# EasyEDA Pro project STM32G303的双FOC电机驱动.eprj, schematic axdr_v1.2
Board Name: foc_driver_1; Create Date: 2024-01-29; Page Name: P1; Project Name: 基于STM32G4的FOC电机驱动学习板; Schematic Name: schematic1; Update Date: 2024-02-05; Company: 嘉立创EDA
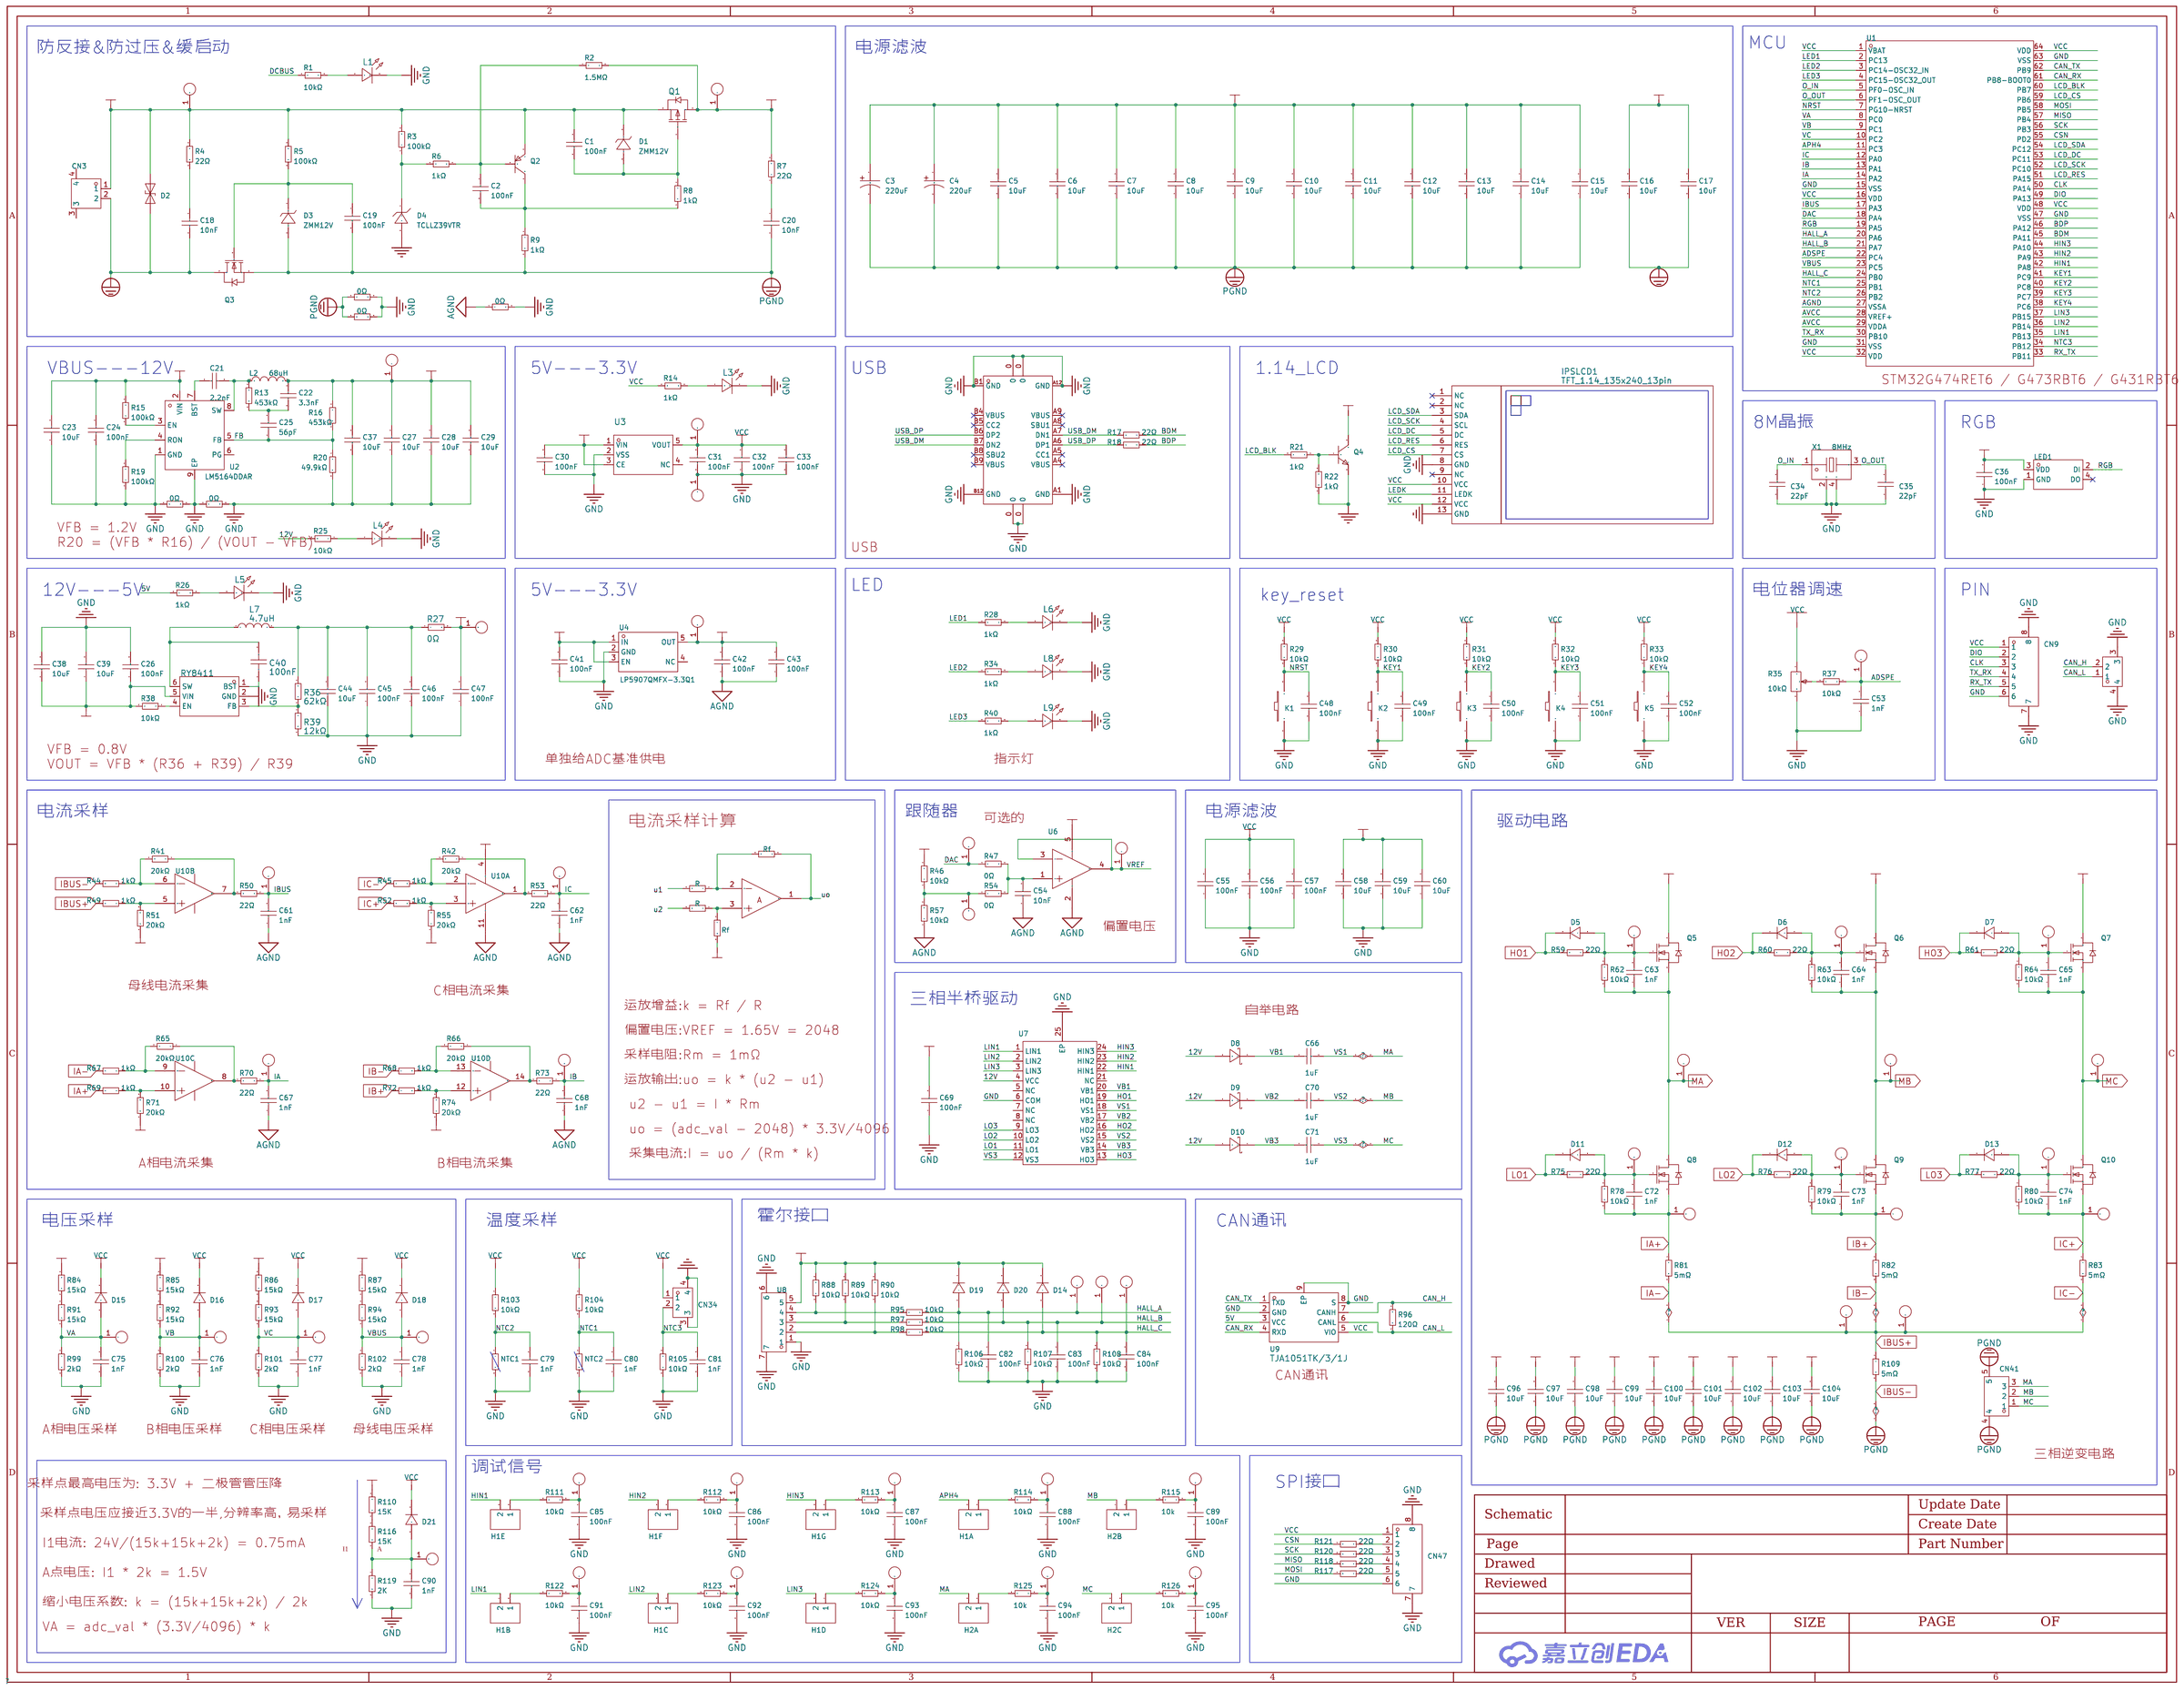
[diagram p0: schematic sheet]

## Parts
C1  100nF  [C0603_S]
C2  100nF  [C0603_S]
C3  220uF  [CAP-SMD_BD10.0-L10.3-W10.3-LS11.0-R-RD]
C4  220uF  [CAP-SMD_BD10.0-L10.3-W10.3-LS11.0-R-RD]
C5  10uF  [C1206_S]
C6  10uF  [C1206_S]
C7  10uF  [C1206_S]
C8  10uF  [C1206_S]
C9  10uF  [C1206_S]
C10  10uF  [C1206_S]
C11  10uF  [C1206_S]
C12  10uF  [C1206_S]
C13  10uF  [C1206_S]
C14  10uF  [C1206_S]
C15  10uF  [C1206_S]
C16  10uF  [C1206_S]
C17  10uF  [C1206_S]
C18  10nF  [C0603_S]
C19  100nF  [C0603_S]
C20  10nF  [C0603_S]
C21  2.2nF  [C0603_S]
C22  3.3nF  [C0603_S]
C23  10uF  [C1206_S]
C24  100nF  [C1206_S]
C25  2.2nF  [C0603_S]
C26  100nF  [C0603_S]
C27  10uF  [C0603_S]
C28  10uF  [C0603_S]
C29  10uF  [C1206_S]
C30  100nF  [C0603_S]
C31  100nF  [C0603_S]
C32  100nF  [C0603_S]
C33  100nF  [C0603_S]
C34  22pF  [C0603_S]
C35  22pF  [C0603_S]
C36  100nF  [C0603_S]
C37  10uF  [C0603_S]
C38  10uF  [C0603_S]
C39  10uF  [C0603_S]
C40  100nF  [C0603_S_3]
C41  100nF  [C0603_S]
C42  100nF  [C0603_S]
C43  100nF  [C0603_S]
C44  10uF  [C0805_S]
C45  100nF  [C0603_S]
C46  100nF  [C0603_S]
C47  100nF  [C0603_S]
C48  100nF  [C0603_S]
C49  100nF  [C0603_S]
C50  100nF  [C0603_S]
C51  100nF  [C0603_S]
C52  100nF  [C0603_S]
C53  1nF  [C0603_S]
C54  10nF  [C0603_S]
C55  100nF  [C0603_S]
C56  100nF  [C0603_S]
C57  100nF  [C0603_S]
C58  10uF  [C0603_S]
C59  10uF  [C0603_S]
C60  10uF  [C0603_S]
C61  1nF  [C0603_S]
C62  1nF  [C0603_S]
C63  1nF  [C0603_S]
C64  1nF  [C0603_S]
C65  1nF  [C0603_S]
C66  1uF  [C0603_S]
C67  1nF  [C0603_S]
C68  1nF  [C0603_S]
C69  100nF  [C0603_S]
C70  1uF  [C0603_S]
C71  1uF  [C0603_S]
C72  1nF  [C0603_S]
C73  1nF  [C0603_S]
C74  1nF  [C0603_S]
C75  1nF  [C0603_S]
C76  1nF  [C0603_S]
C77  1nF  [C0603_S]
C78  1nF  [C0603_S]
C79  1nF  [C0603_S]
C80  1nF  [C0603_S]
C81  1nF  [C0603_S]
C82  100nF  [C0603_S]
C83  100nF  [C0603_S]
C84  100nF  [C0603_S]
C85  100nF  [C0603_S]
C86  100nF  [C0603_S]
C87  100nF  [C0603_S]
C88  100nF  [C0603_S]
C89  100nF  [C0603_S]  (no BOM)
C90  1nF  [C0603_S]  (no BOM)
C91  100nF  [C0603_S]
C92  100nF  [C0603_S]
C93  100nF  [C0603_S]
C94  100nF  [C0603_S]  (no BOM)
C95  100nF  [C0603_S]  (no BOM)
C96  10uF  [C1206_S]
C97  10uF  [C1206_S]
C98  10uF  [C1206_S]
C99  10uF  [C1206_S]
C100  10uF  [C1206_S]
C101  10uF  [C1206_S]
C102  10uF  [C1206_S]
C103  10uF  [C1206_S]
C104  10uF  [C1206_S]
CN1  5012  [TESTPOINT-TH_BD2.0_C9900010656]  (no BOM)
CN2  5012  [TESTPOINT-TH_BD2.0_C9900010656]  (no BOM)
CN3  XT30PW-F  [CONN-TH_XT30PW-F]
CN4  5012  [TESTPOINT-TH_BD2.0_C9900010656]  (no BOM)
CN5  5012  [TESTPOINT-TH_BD2.0_C9900010656]  (no BOM)
CN6  5012  [TESTPOINT-TH_BD2.0_C9900010656]  (no BOM)
CN7  5012  [TESTPOINT-TH_BD2.0_C9900010656]  (no BOM)
CN8  5012  [TESTPOINT-TH_BD2.0_C9900010656]  (no BOM)
CN9  WAFER-GH1.25-6PWB  [CONN-SMD_6P-P1.25_XUNPU_WAFER-GH1.25-6PWB]
CN10  5012  [TESTPOINT-TH_BD2.0_C9900010656]  (no BOM)
CN11  X1251WRS-02HF-LPSW  [CONN-SMD_2P-P1.25_X1251WRS-02HF-LPSW]
CN12  5012  [TESTPOINT-TH_BD2.0_C9900010656]  (no BOM)
CN13  5012  [TESTPOINT-TH_BD2.0_C9900010656]  (no BOM)
CN14  5012  [TESTPOINT-TH_BD2.0_C9900010656]  (no BOM)
CN15  5012  [TESTPOINT-TH_BD2.0_C9900010656]  (no BOM)
CN16  5012  [TESTPOINT-TH_BD2.0_C9900010656]  (no BOM)
CN17  5012  [TESTPOINT-TH_BD2.0_C9900010656]  (no BOM)
CN18  5012  [TESTPOINT-TH_BD2.0_C9900010656]  (no BOM)
CN19  5012  [TESTPOINT-TH_BD2.0_C9900010656]  (no BOM)
CN20  5012  [TESTPOINT-TH_BD2.0_C9900010656]  (no BOM)
CN21  5012  [TESTPOINT-TH_BD2.0_C9900010656]  (no BOM)
CN22  5012  [TESTPOINT-TH_BD2.0_C9900010656]  (no BOM)
CN23  5012  [TESTPOINT-TH_BD2.0_C9900010656]  (no BOM)
CN24  5012  [TESTPOINT-TH_BD2.0_C9900010656]  (no BOM)
CN25  5012  [TESTPOINT-TH_BD2.0_C9900010656]  (no BOM)
CN26  5012  [TESTPOINT-TH_BD2.0_C9900010656]  (no BOM)
CN27  5012  [TESTPOINT-TH_BD2.0_C9900010656]  (no BOM)
CN28  5012  [TESTPOINT-TH_BD2.0_C9900010656]  (no BOM)
CN29  5012  [TESTPOINT-TH_BD2.0_C9900010656]  (no BOM)
CN30  5012  [TESTPOINT-TH_BD2.0_C9900010656]  (no BOM)
CN31  5012  [TESTPOINT-TH_BD2.0_C9900010656]  (no BOM)
CN32  5012  [TESTPOINT-TH_BD2.0_C9900010656]  (no BOM)
CN33  5012  [TESTPOINT-TH_BD2.0_C9900010656]  (no BOM)
CN34  X1251WRS-02HF-LPSW  [CONN-SMD_2P-P1.25_X1251WRS-02HF-LPSW]
CN35  5012  [TESTPOINT-TH_BD2.0_C9900010656]  (no BOM)
CN36  5012  [TESTPOINT-TH_BD2.0_C9900010656]  (no BOM)
CN37  5012  [TESTPOINT-TH_BD2.0_C9900010656]  (no BOM)
CN38  5012  [TESTPOINT-TH_BD2.0_C9900010656]  (no BOM)
CN39  5012  [TESTPOINT-TH_BD2.0_C9900010656]  (no BOM)
CN40  5012  [TESTPOINT-TH_BD2.0_C9900010656]  (no BOM)
CN41  MR30PW-F  [CONN-TH_MR30PW-F]
CN42  5012  [TESTPOINT-TH_BD2.0_C9900010656]  (no BOM)
CN43  5012  [TESTPOINT-TH_BD2.0_C9900010656]  (no BOM)
CN44  5012  [TESTPOINT-TH_BD2.0_C9900010656]  (no BOM)
CN45  5012  [TESTPOINT-TH_BD2.0_C9900010656]  (no BOM)
CN46  5012  [TESTPOINT-TH_BD2.0_C9900010656]  (no BOM)
CN47  WAFER-GH1.25-6PWB  [CONN-SMD_6P-P1.25_XUNPU_WAFER-GH1.25-6PWB]
CN48  5012  [TESTPOINT-TH_BD2.0_C9900010656]  (no BOM)
CN49  5012  [TESTPOINT-TH_BD2.0_C9900010656]  (no BOM)
CN50  5012  [TESTPOINT-TH_BD2.0_C9900010656]  (no BOM)
CN51  5012  [TESTPOINT-TH_BD2.0_C9900010656]  (no BOM)
CN52  5012  [TESTPOINT-TH_BD2.0_C9900010656]  (no BOM)
CN53  5012  [TESTPOINT-TH_BD2.0_C9900010656]  (no BOM)
D1  ZMM12V  [LL-34_L3.5-W1.5-RD-2]
D2  1.5SMC30CAHE3/57T  [SMC_L6.8-W5.9-LS7.8-BI]
D3  ZMM12V  [LL-34_L3.5-W1.5-RD-2]
D4  TCLLZ39VTR  [LL-34_L3.5-W1.5-RD]
D5  B16WS  [SOD-323_L1.8-W1.3-LS2.5-RD]
D6  B16WS  [SOD-323_L1.8-W1.3-LS2.5-RD]
D7  B16WS  [SOD-323_L1.8-W1.3-LS2.5-RD]
D8  B16WS  [SOD-323_L1.8-W1.3-LS2.5-RD]
D9  B16WS  [SOD-323_L1.8-W1.3-LS2.5-RD]
D10  B16WS  [SOD-323_L1.8-W1.3-LS2.5-RD]
D11  B16WS  [SOD-323_L1.8-W1.3-LS2.5-RD]
D12  B16WS  [SOD-323_L1.8-W1.3-LS2.5-RD]
D13  B16WS  [SOD-323_L1.8-W1.3-LS2.5-RD]
D14  B16WS  [SOD-323_L1.8-W1.3-LS2.5-RD]
D15  B16WS  [SOD-323_L1.8-W1.3-LS2.5-RD]
D16  B16WS  [SOD-323_L1.8-W1.3-LS2.5-RD]
D17  B16WS  [SOD-323_L1.8-W1.3-LS2.5-RD]
D18  B16WS  [SOD-323_L1.8-W1.3-LS2.5-RD]
D19  B16WS  [SOD-323_L1.8-W1.3-LS2.5-RD]
D20  B16WS  [SOD-323_L1.8-W1.3-LS2.5-RD]
D21  -  [SOD-323_L1.8-W1.3-LS2.5-RD]  (no BOM)
H1  2.54-2*7P针  [HDR-TH_14P-P2.54-V-F-R2-C6-S2.54]  (sections 1,2,3,4,5,6,7)
H2  X6521WV-2x03H-C60D30  [HDR-TH_6P-P2.54-V-M-R2-C3-S2.54]  (sections 1,2,3)  (no BOM)
IPSLCD1  TFT_1.14_135x240_13pin  [焊接式_TFT_1.14_135X240_13PIN]
K1  TS-KG02S  [SW-SMD_4P-L6.0-W6.0-P4.50-LS8.5]
K2  TS-KG02S  [SW-SMD_4P-L6.0-W6.0-P4.50-LS8.5]
K3  TS-KG02S  [SW-SMD_4P-L6.0-W6.0-P4.50-LS8.5]
K4  TS-KG02S  [SW-SMD_4P-L6.0-W6.0-P4.50-LS8.5]
K5  TS-KG02S  [SW-SMD_4P-L6.0-W6.0-P4.50-LS8.5]
L1  NCD0603R1  [LED0603_S]
L2  68uH  [IND-SMD_L6.0-W6.0_SMNR6045]
L3  NCD0603R1  [LED0603_S]
L4  NCD0603R1  [LED0603_S]
L5  NCD0603R1  [LED0603_S]
L6  NCD0603G1  [LED0603_S]
L7  4.7uH  [IND-SMD_L2.5-W2.0]
L8  NCD0603W1  [LED0603_S]
L9  NCD0603B1  [LED0603_S]
LED1  XL-3528RGBW-WS2812B  [LED-SMD_4P-L3.5-W2.8-BR-1]
NTC1  NCP18XH103F03RB  [R0603_S]
NTC2  NCP18XH103F03RB  [R0603_S]
Q1  WSD90P06DN56  [DFN-8_L5.8-W4.9-P1.27-LS6.0-BL-1]
Q2  FMMT593  [SOT-23-3_L2.9-W1.3-P1.90-LS2.4-BR]
Q3  WSD80120DN56  [DFN-8_L5.8-W4.9-P1.27-LS6.0-BL-1]
Q4  SS8050  [SOT-23-3_L2.9-W1.3-P1.90-LS2.4-BR]
Q5  NCE7560K  [TO-252-2_L6.6-W6.1-P4.58-LS9.9-BR]
Q6  NCE7560K  [TO-252-2_L6.6-W6.1-P4.58-LS9.9-BR]
Q7  NCE7560K  [TO-252-2_L6.6-W6.1-P4.58-LS9.9-BR]
Q8  NCE7560K  [TO-252-2_L6.6-W6.1-P4.58-LS9.9-BR]
Q9  NCE7560K  [TO-252-2_L6.6-W6.1-P4.58-LS9.9-BR]
Q10  NCE7560K  [TO-252-2_L6.6-W6.1-P4.58-LS9.9-BR]
R1  10kΩ  [R0603_S]
R2  1.5MΩ  [R0603_S]
R3  100kΩ  [R0603_S]
R4  22Ω  [R0603_S]
R5  100kΩ  [R0603_S]
R6  1kΩ  [R0603_S]
R7  22Ω  [R0603_S]
R8  1kΩ  [R0603_S]
R9  1kΩ  [R0603_S]
R10  0Ω  [R0603_S]
R11  0Ω  [R0603_S]
R12  0Ω  [R0603_S]
R13  453kΩ  [R0603_S]
R14  1kΩ  [R0603_S]
R15  100kΩ  [R0603_S]
R16  453kΩ  [R0603_S]
R17  22Ω  [R0603_S]
R18  22Ω  [R0603_S]
R19  100kΩ  [R0603_S]
R20  49.9kΩ  [R0603_S]
R21  1kΩ  [R0603_S]
R22  1kΩ  [R0603_S]
R23  0Ω  [R0603_S]
R24  0Ω  [R0603_S]
R25  10kΩ  [R0603_S]
R26  1kΩ  [R0603_S]
R27  0Ω  [R0603_S]
R28  1kΩ  [R0603_S]
R29  10kΩ  [R0603_S]
R30  10kΩ  [R0603_S]
R31  10kΩ  [R0603_S]
R32  10kΩ  [R0603_S]
R33  10kΩ  [R0603_S]
R34  1kΩ  [R0603_S]
R35  10kΩ  [RES-ADJ-TH_3P-L9.5-W9.5-P2.50-L_3386P]
R36  62kΩ  [R0603_S]
R37  10kΩ  [R0603_S]
R38  10kΩ  [R0603_S]
R39  12kΩ  [R0603_S]
R40  1kΩ  [R0603_S]
R41  20kΩ  [R0603_S]
R42  20kΩ  [R0603_S]
R43  Rf  [R0603_S]  (no BOM)
R44  1kΩ  [R0603_S]
R45  1kΩ  [R0603_S]
R46  10kΩ  [R0603_S]
R47  0Ω  [R0603_S]
R48  R  [R0603_S]  (no BOM)
R49  1kΩ  [R0603_S]
R50  22Ω  [R0603_S]
R51  20kΩ  [R0603_S]
R52  1kΩ  [R0603_S]
R53  22Ω  [R0603_S]
R54  0Ω  [R0603_S]
R55  20kΩ  [R0603_S]
R56  R  [R0603_S]  (no BOM)
R57  10kΩ  [R0603_S]
R58  Rf  [R0603_S]  (no BOM)
R59  22Ω  [R0603_S]
R60  22Ω  [R0603_S]
R61  22Ω  [R0603_S]
R62  10kΩ  [R0603_S]
R63  10kΩ  [R0603_S]
R64  10kΩ  [R0603_S]
R65  20kΩ  [R0603_S]
R66  20kΩ  [R0603_S]
R67  1kΩ  [R0603_S]
R68  1kΩ  [R0603_S]
R69  1kΩ  [R0603_S]
R70  22Ω  [R0603_S]
R71  20kΩ  [R0603_S]
R72  1kΩ  [R0603_S]
R73  22Ω  [R0603_S]
R74  20kΩ  [R0603_S]
R75  22Ω  [R0603_S]
R76  22Ω  [R0603_S]
R77  22Ω  [R0603_S]
R78  10kΩ  [R0603_S]
R79  10kΩ  [R0603_S]
R80  10kΩ  [R0603_S]
R81  5mΩ  [R2512_S]
R82  5mΩ  [R2512_S]
R83  5mΩ  [R2512_S]
R84  15kΩ  [R0603_S]
R85  15kΩ  [R0603_S]
R86  15kΩ  [R0603_S]
R87  15kΩ  [R0603_S]
R88  10kΩ  [R0603_S]
R89  10kΩ  [R0603_S]
R90  10kΩ  [R0603_S]
R91  15kΩ  [R0603_S]
R92  15kΩ  [R0603_S]
R93  15kΩ  [R0603_S]
R94  15kΩ  [R0603_S]
R95  10kΩ  [R0603_S]
R96  120Ω  [R0603_S]
R97  10kΩ  [R0603_S]
R98  10kΩ  [R0603_S]
R99  2kΩ  [R0603_S]
R100  2kΩ  [R0603_S]
R101  2kΩ  [R0603_S]
R102  2kΩ  [R0603_S]
R103  10kΩ  [R0603_S]
R104  10kΩ  [R0603_S]
R105  10kΩ  [R0603_S]
R106  10kΩ  [R0603_S]
R107  10kΩ  [R0603_S]
R108  10kΩ  [R0603_S]
R109  5mΩ  [R2512_S]
R110  15K  [R0603_S]  (no BOM)
R111  10kΩ  [R0603_S]
R112  10kΩ  [R0603_S]
R113  10kΩ  [R0603_S]
R114  10kΩ  [R0603_S]
R115  10k  [R0603_S]  (no BOM)
R116  15K  [R0603_S]  (no BOM)
R117  22Ω  [R0603_S]
R118  22Ω  [R0603_S]
R119  2K  [R0603_S]  (no BOM)
R120  22Ω  [R0603_S]
R121  22Ω  [R0603_S]
R122  10kΩ  [R0603_S]
R123  10kΩ  [R0603_S]
R124  10kΩ  [R0603_S]
R125  10k  [R0603_S]  (no BOM)
R126  10k  [R0603_S]  (no BOM)
U1  STM32G431RBT6  [LQFP-64_L10.0-W10.0-P0.50-LS12.0-BL]
U2  LM5164DDAR  [ESOP-8_L4.9-W3.9-P1.27-LS6.0-BL-EP]
U3  XC6210B332MR  [SOT-23-5_L3.0-W1.7-P0.95-LS2.8-BR]
U4  LP5907QMFX-3.3Q1  [SOT-23-5_L3.0-W1.7-P0.95-LS2.8-BR]
U5  RY8411  [SOT-23-6_L2.9-W1.6-P0.95-LS2.8-BR]
U6  LM321MF/NOPB  [SOT-23-5_L3.0-W1.7-P0.95-LS2.8-BR]
U7  FD6288Q  [QFN-24_L4.0-W4.0-P0.50-BL-EP2.6]
U8  WAFER-GH1.25-5PWB  [CONN-SMD_5P-P1.25_XUNPU_WAFER-GH1.25-5PWB]
U9  TJA1051TK/3/1J  [HVSON-8_L3.0-W3.0-P0.65-BL-EP]
U10  RS624XQ  [TSSOP-14_L5.0-W4.4-P0.65-LS6.4-BL]  (sections 1,2,3,4)
U11  LM358  [SOP-8_L4.9-W3.9-P1.27-LS6.0-BL]  (section 1)  (no BOM)
USBC1  -  [USB-C_SMD-TYPE-C-31-M-12]
X1  8MHz  [CRYSTAL-SMD_4P-L3.2-W2.5-BL]

## Library data of the parts
C1 C2 C19 C26 C30-C33 C36 C41-C43 C45-C52 C55-C57 C69 C82-C88 C91-C93 = 0603B104K500NT: 容值:100nF;精度:±10%;额定电压:50V;材质(温度系数):X7R;; LCSC Part Name: 100nF ±10% 50V; Supplier Part: C30926; Manufacturer: FH(风华); Supplier Footprint: 0603; JLCPCB Part Class: Extended Part; Datasheet: https://atta.szlcsc.com/upload/public/pdf/source/20200305/C486355_26A10D38EF8C2A5C37091D0039909270.pdf; Supplier: LCSC; Tolerance: ±10%; Voltage Rated: 50V; Temperature Coefficient: X7R; Pin Type: IN; Check: true
C3 C4 = 50TZV220M10X10.5: 容值:220uF;精度:±20%;额定电压:50V;纹波电流:402mA@120Hz;等效串联电阻:-;; LCSC Part Name: 220uF ±20% 50V; Supplier Part: C88818; Manufacturer: rubycon(红宝石); Supplier Footprint: SMD,D10xL10.5mm; JLCPCB Part Class: Extended Part; Datasheet: https://atta.szlcsc.com/upload/public/pdf/source/20171014/C108861_15079752546651037911.pdf; Supplier: LCSC; Tolerance: ±20%; Rated Voltage: 50V; Ripple Current: 402mA@120Hz; φD: 10mm; L: 10.5mm; Lifetime @ Temp: 2000hrs@105℃; Operating Temperature: -55℃~+105℃; Check: true
C5-C17 C29 C96-C104 = CL31A106KBHNNNE: 容值:10uF;精度:±10%;额定电压:50V;材质(温度系数):X5R;; LCSC Part Name: 10uF ±10% 50V; Supplier Part: C13585; Manufacturer: SAMSUNG(三星); Supplier Footprint: 1206; JLCPCB Part Class: Basic Part; Datasheet: https://atta.szlcsc.com/upload/public/pdf/source/20160218/1457707763339.pdf; Supplier: LCSC; Tolerance: ±10%; Voltage Rated: 50V; Temperature Coefficient: X5R; Pin Type: IN; 值: 10UF; Check: true
C18 C20 C54 = 0603B103K500NT: 容值:10nF;精度:±10%;额定电压:50V;材质(温度系数):X7R;; LCSC Part Name: 10nF ±10% 50V; Supplier Part: C57112; Manufacturer: FH(风华); Supplier Footprint: 0603; JLCPCB Part Class: Basic Part; Datasheet: https://atta.szlcsc.com/upload/public/pdf/source/20200305/C486355_26A10D38EF8C2A5C37091D0039909270.pdf; Supplier: LCSC; Tolerance: ±10%; Voltage Rated: 50V; Temperature Coefficient: X7R; Pin Type: IN; Check: true
C21 C25 = 0603B222K500NT: 容值:2.2nF;精度:±10%;额定电压:50V;材质(温度系数):X7R;; LCSC Part Name: 2.2nF ±10% 50V; Supplier Part: C1604; Manufacturer: FH(风华); Supplier Footprint: 0603; JLCPCB Part Class: Basic Part; Datasheet: https://atta.szlcsc.com/upload/public/pdf/source/20200305/C486355_26A10D38EF8C2A5C37091D0039909270.pdf; Supplier: LCSC; Tolerance: ±10%; Voltage Rated: 50V; Temperature Coefficient: X7R; Pin Type: IN; Check: true
C22 = CL10B332KB8NNNC: 容值:3.3nF;精度:±10%;额定电压:50V;材质(温度系数):X7R;; LCSC Part Name: 3.3nF ±10% 50V; Supplier Part: C1613; Manufacturer: SAMSUNG(三星); Supplier Footprint: 0603; JLCPCB Part Class: Basic Part; Datasheet: https://atta.szlcsc.com/upload/public/pdf/source/20160218/1457707763339.pdf; Supplier: LCSC; Tolerance: ±10%; Voltage Rated: 50V; Temperature Coefficient: X7R; Pin Type: IN; Check: true
C23 = C1206_S: Pin Type: IN; Supplier Part: C13585; Check: true
C24 = CL31B104KBCNNNC: 容值:100nF;精度:±10%;额定电压:50V;材质(温度系数):X7R;; LCSC Part Name: 100nF ±10% 50V; Supplier Part: C24497; Manufacturer: SAMSUNG(三星); Supplier Footprint: 1206; JLCPCB Part Class: Basic Part; Datasheet: https://atta.szlcsc.com/upload/public/pdf/source/20160218/1457707763339.pdf; Supplier: LCSC; Tolerance: ±10%; Voltage Rated: 50V; Temperature Coefficient: X7R; Pin Type: IN; Check: true
C27 C28 C37-C39 C58-C60 = CL10A106MA8NRNC: 容值:10uF;精度:±20%;额定电压:25V;材质(温度系数):X5R;; LCSC Part Name: 10uF ±20% 25V; Supplier Part: C96446; Manufacturer: SAMSUNG(三星); Supplier Footprint: 0603; JLCPCB Part Class: Basic Part; Datasheet: https://atta.szlcsc.com/upload/public/pdf/source/20160218/1457707763339.pdf; Supplier: LCSC; Tolerance: ±20%; Voltage Rated: 25V; Temperature Coefficient: X5R; Pin Type: IN; Check: true
C34 C35 = 0603CG220J500NT: 容值:22pF;精度:±5%;额定电压:50V;材质(温度系数):C0G;; LCSC Part Name: 22pF ±5% 50V; Supplier Part: C91701; Manufacturer: FH(风华); Supplier Footprint: 0603; JLCPCB Part Class: Extended Part; Datasheet: https://atta.szlcsc.com/upload/public/pdf/source/20200305/C486355_26A10D38EF8C2A5C37091D0039909270.pdf; Supplier: LCSC; Tolerance: ±5%; Voltage Rated: 50V; Temperature Coefficient: C0G; Pin Type: IN; Check: true
C40 = CC0603KRX7R9BB104: 容值:100nF;精度:±10%;额定电压:50V;材质(温度系数):X7R;; LCSC Part Name: 100nF ±10% 50V; Supplier Part: C14663; Manufacturer: YAGEO(国巨); Supplier Footprint: 0603; JLCPCB Part Class: Basic Part; Datasheet: https://atta.szlcsc.com/upload/public/pdf/source/20180910/C282072_33301C7F631E79921B82A8DAC6BCC5B3.pdf; Supplier: LCSC; Tolerance: ±10%; Voltage Rated: 50V; Temperature Coefficient: X7R; Check: true
C44 = CL21A106KAYNNNE_C15850: 容值:10uF;精度:±10%;额定电压:25V;材质(温度系数):X5R;; LCSC Part Name: 10uF ±10% 25V; Supplier Part: C15850; Manufacturer: SAMSUNG(三星); Manufacturer Part: CL21A106KAYNNNE; Supplier Footprint: 0805; JLCPCB Part Class: Basic Part; Datasheet: https://atta.szlcsc.com/upload/public/pdf/source/20160103/1457707679302.pdf; Supplier: LCSC; Tolerance: ±10%; Voltage Rated: 25V; Temperature Coefficient: X5R; Pin Type: IN; Check: true
C53 C61-C65 C67 C68 C72-C81 = 0603B102K500NT: 容值:1nF;精度:±10%;额定电压:50V;材质(温度系数):X7R;; LCSC Part Name: 1nF ±10% 50V; Supplier Part: C44369; Manufacturer: FH(风华); Supplier Footprint: 0603; JLCPCB Part Class: Extended Part; Datasheet: https://atta.szlcsc.com/upload/public/pdf/source/20200305/C486355_26A10D38EF8C2A5C37091D0039909270.pdf; Supplier: LCSC; Tolerance: ±10%; Voltage Rated: 50V; Temperature Coefficient: X7R; Pin Type: IN; Check: true
C66 C70 C71 C89 C90 C94 C95 = C0603_S: Pin Type: IN; Supplier Part: C1604; Check: true
CN1 CN2 CN4-CN8 CN10 CN12-CN33 CN35-CN40 CN42-CN46 CN48-CN53 = 5012: LCSC Part Name: 测试点; Supplier Part: C2906766; Manufacturer: Keystone; JLCPCB Part Class: ExtendedPart; Datasheet: https://atta.szlcsc.com/upload/public/pdf/source/20211102/12102DF701EA335825673F0350517149.pdf; Supplier: LCSC; Check: true
CN3 = XT30PW-F: 类别:-;类型1:-;; LCSC Part Name: AMASS(艾迈斯)电源连接器 母头 XT30PW-F; Supplier Part: C2913282; Manufacturer: AMASS(艾迈斯); JLCPCB Part Class: Extended Part; Datasheet: https://atta.szlcsc.com/upload/public/pdf/source/20190916/C428722_DFF78979486FCB0B58C1FC563067EC88.pdf; Supplier: LCSC; Brand: 艾迈斯; Type: 航模插头; InterfaceType: 母头; Check: true
CN9 CN47 = WAFER-GH1.25-6PWB: 参考系列:GH;间距:1.25mm;插针结构:1x6P;排数:1;每排PIN数:6;公母:公型插针;安装方式:卧贴;额定电流:1A;工作温度范围:-25~+85;; LCSC Part Name: GH1.25mm6P卧贴带扣带扣; Supplier Part: C3029381; Manufacturer: XUNPU(讯普); Supplier Footprint: SMD,P=1.25mm; JLCPCB Part Class: ExtendedPart; Datasheet: https://atta.szlcsc.com/upload/public/pdf/source/20220527/CB8773BFB0913C3B8ABD62CB38BA101A.pdf; Supplier: LCSC; Reference Series: GH; Pitch: 1.25mm; Pins Structure: 1x6P; Number of Rows: 1; Number of PINs Per Row: 6; Gender: 公型插针; Mounting Style: 卧贴; Current Rating (Max): 1A; Operating Temperature Range: -25~+85; Check: true
CN11 CN34 = X1251WRS-02HF-LPSW: 插针结构:1x2P;间距:1.25mm;安装方式:卧贴;行距:-;总PIN数:2P;排数:1;每排PIN数:2;参考系列:GH;额定电流:1A;触头材质:磷青铜;触头镀层:锡;工作温度范围:-40℃~+110℃;; LCSC Part Name: 1x2P 间距:1.25mm 卧贴 系列:GH GH; Supplier Part: C388707; Manufacturer: XKB Connectivity(中国星坤); Supplier Footprint: SMD,P=1.25mm; JLCPCB Part Class: Extended Part; Datasheet: https://atta.szlcsc.com/upload/public/pdf/source/20211011/E2F7306AE87519079AD4EC816349A567.pdf; Supplier: LCSC; Reference Series: GH; Pitch: 1.25mm; Pins Structure: 1x2P; Number of Rows: 1; Number of PINs Per Row: 2; Gender: 母型插口; Mounting Style: 卧贴; Current Rating (Max): 1A; Contact Material: 磷青铜; Contact Plating: 锡; Operating Temperature Range: -40℃~+110℃; Welding Temperature (Max): 260℃; Number of Pins: 2P; Check: true
CN41 = MR30PW-F: Supplier Part: C2928110; Supplier Footprint: Through hole; JLCPCB Part Class: Extended Part; Supplier: LCSC; Check: true
D1 D3 = ZMM12V: 二极管配置:独立式;稳压值(标称值):12V;稳压值(范围):11.4V~12.7V;功率:500mW;精度:±5%;; Supplier Part: C2891753; Manufacturer: YONGYUTAI(永裕泰); Supplier Footprint: LL-34; JLCPCB Part Class: Extended Part; Datasheet: https://atta.szlcsc.com/upload/public/pdf/source/20210901/1E62BEB6ADBB84BC625F53DAC2865793.pdf; Supplier: LCSC; Diode Configuration: 独立式; Zener Voltage (Nom): 12V; Zener Voltage (Range): 11.4V~12.7V; Power Dissipation: 500mW; Zener Impedance (Zzt): 20Ω; Tolerance: ±5%; Check: true
D2 = 1.5SMC30CAHE3/57T: Supplier Part: C266791; Manufacturer: VISHAY(威世); Supplier Footprint: DO-214AB; JLCPCB Part Class: ExtendedPart; Datasheet: https://atta.szlcsc.com/upload/public/pdf/source/20201127/C266791_DCFCBF6E8C40544EF502CA57B31F9E9C.pdf; Supplier: LCSC; Check: true
D4 = TCLLZ39VTR: 二极管配置:独立式;稳压值(标称值):39V;精度:±5%;功率:500mW;; Supplier Part: C261065; Manufacturer: TC(德昌); Supplier Footprint: LL-34; JLCPCB Part Class: Extended Part; Datasheet: https://atta.szlcsc.com/upload/public/pdf/source/20180730/C261180_0E55EF1E5C6C97B03D9678EA0A24BCDF.pdf; Supplier: LCSC; Diode Configuration: 独立式; Zener Voltage (Nom): 39V; Tolerance: ±5%; Power Dissipation: 500mW; Reverse Leakage Current (Ir): 200nA@30V; Zener Impedance (Zzt): 85Ω; Zener Voltage (Range): 31V~35V; Check: true
D5-D7 D11-D20 = B16WS_C364278: 直流反向耐压(Vr):60V;平均整流电流(Io):1A;正向压降(Vf):700mV@1A;; Supplier Part: C364278; Manufacturer: MDD; Supplier Footprint: SOD-323; JLCPCB Part Class: Extended Part; Datasheet: https://atta.szlcsc.com/upload/public/pdf/source/20190125/C364278_08C9E980565605CB111C36D3361AA1D7.pdf; Supplier: LCSC; Reverse Voltage (Vr): 60V; Average Rectified Current (Io): 1A; Forward Voltage (Vf@If): 700mV@1A; Check: true
D8-D10 = B16WS_C364278: 直流反向耐压(Vr):40V;平均整流电流(Io):1A;正向压降(Vf):650mV@1A;; Supplier Part: C364278; Manufacturer: MDD; Supplier Footprint: SOD-323; JLCPCB Part Class: Extended Part; Datasheet: https://atta.szlcsc.com/upload/public/pdf/source/20190125/C364278_08C9E980565605CB111C36D3361AA1D7.pdf; Supplier: LCSC; Reverse Voltage (Vr): 40V; Average Rectified Current (Io): 1A; Forward Voltage (Vf@If): 650mV@1A; Check: true
D21 = B16WS: 直流反向耐压(Vr):60V;平均整流电流(Io):1A;正向压降(Vf):700mV@1A;; LCSC Part Name: 60V1A700mV@1A; Supplier Part: C77282; Manufacturer: CJ（江苏长电/长晶）; Supplier Footprint: SOD-323; JLCPCB Part Class: ExtendedPart; Datasheet: https://atta.szlcsc.com/upload/public/pdf/source/20160702/1467448300850.pdf; Supplier: LCSC; Reverse Voltage (Vr): 60V; Average Rectified Current (Io): 1A; Forward Voltage (Vf@If): 700mV@1A; Check: true
H1 = 2.54-2*7P针: 排数:双排;总PIN位数:14P;间距:2.54mm;插针结构:-;行距:2.54mm;安装类型:直插;圆针/方针:-;额定电流:-;额定电压:-;配合针长度:-;塑高:-;触头材质:-;触头镀层:-;颜色:黑色;; LCSC Part Name: 间距:2.54mm 直插; Supplier Part: C71397; Manufacturer: BOOMELE(博穆精密); Supplier Footprint: 插件,P=2.54mm; JLCPCB Part Class: Extended Part; Datasheet: https://atta.szlcsc.com/upload/public/pdf/source/20221201/C605E3BE9C0F7226363017EFD1BDE852.pdf; Supplier: LCSC; Number of Rows: 双排; Number of Pins: 14P; Pitch: 2.54mm; Row Spacing: 2.54mm; Mounting Type: 直插; Color: 黑色; Check: true